# EasyEDA Pro project kuafu01_030内部老化方案.eprj, board PCB4 (continued)
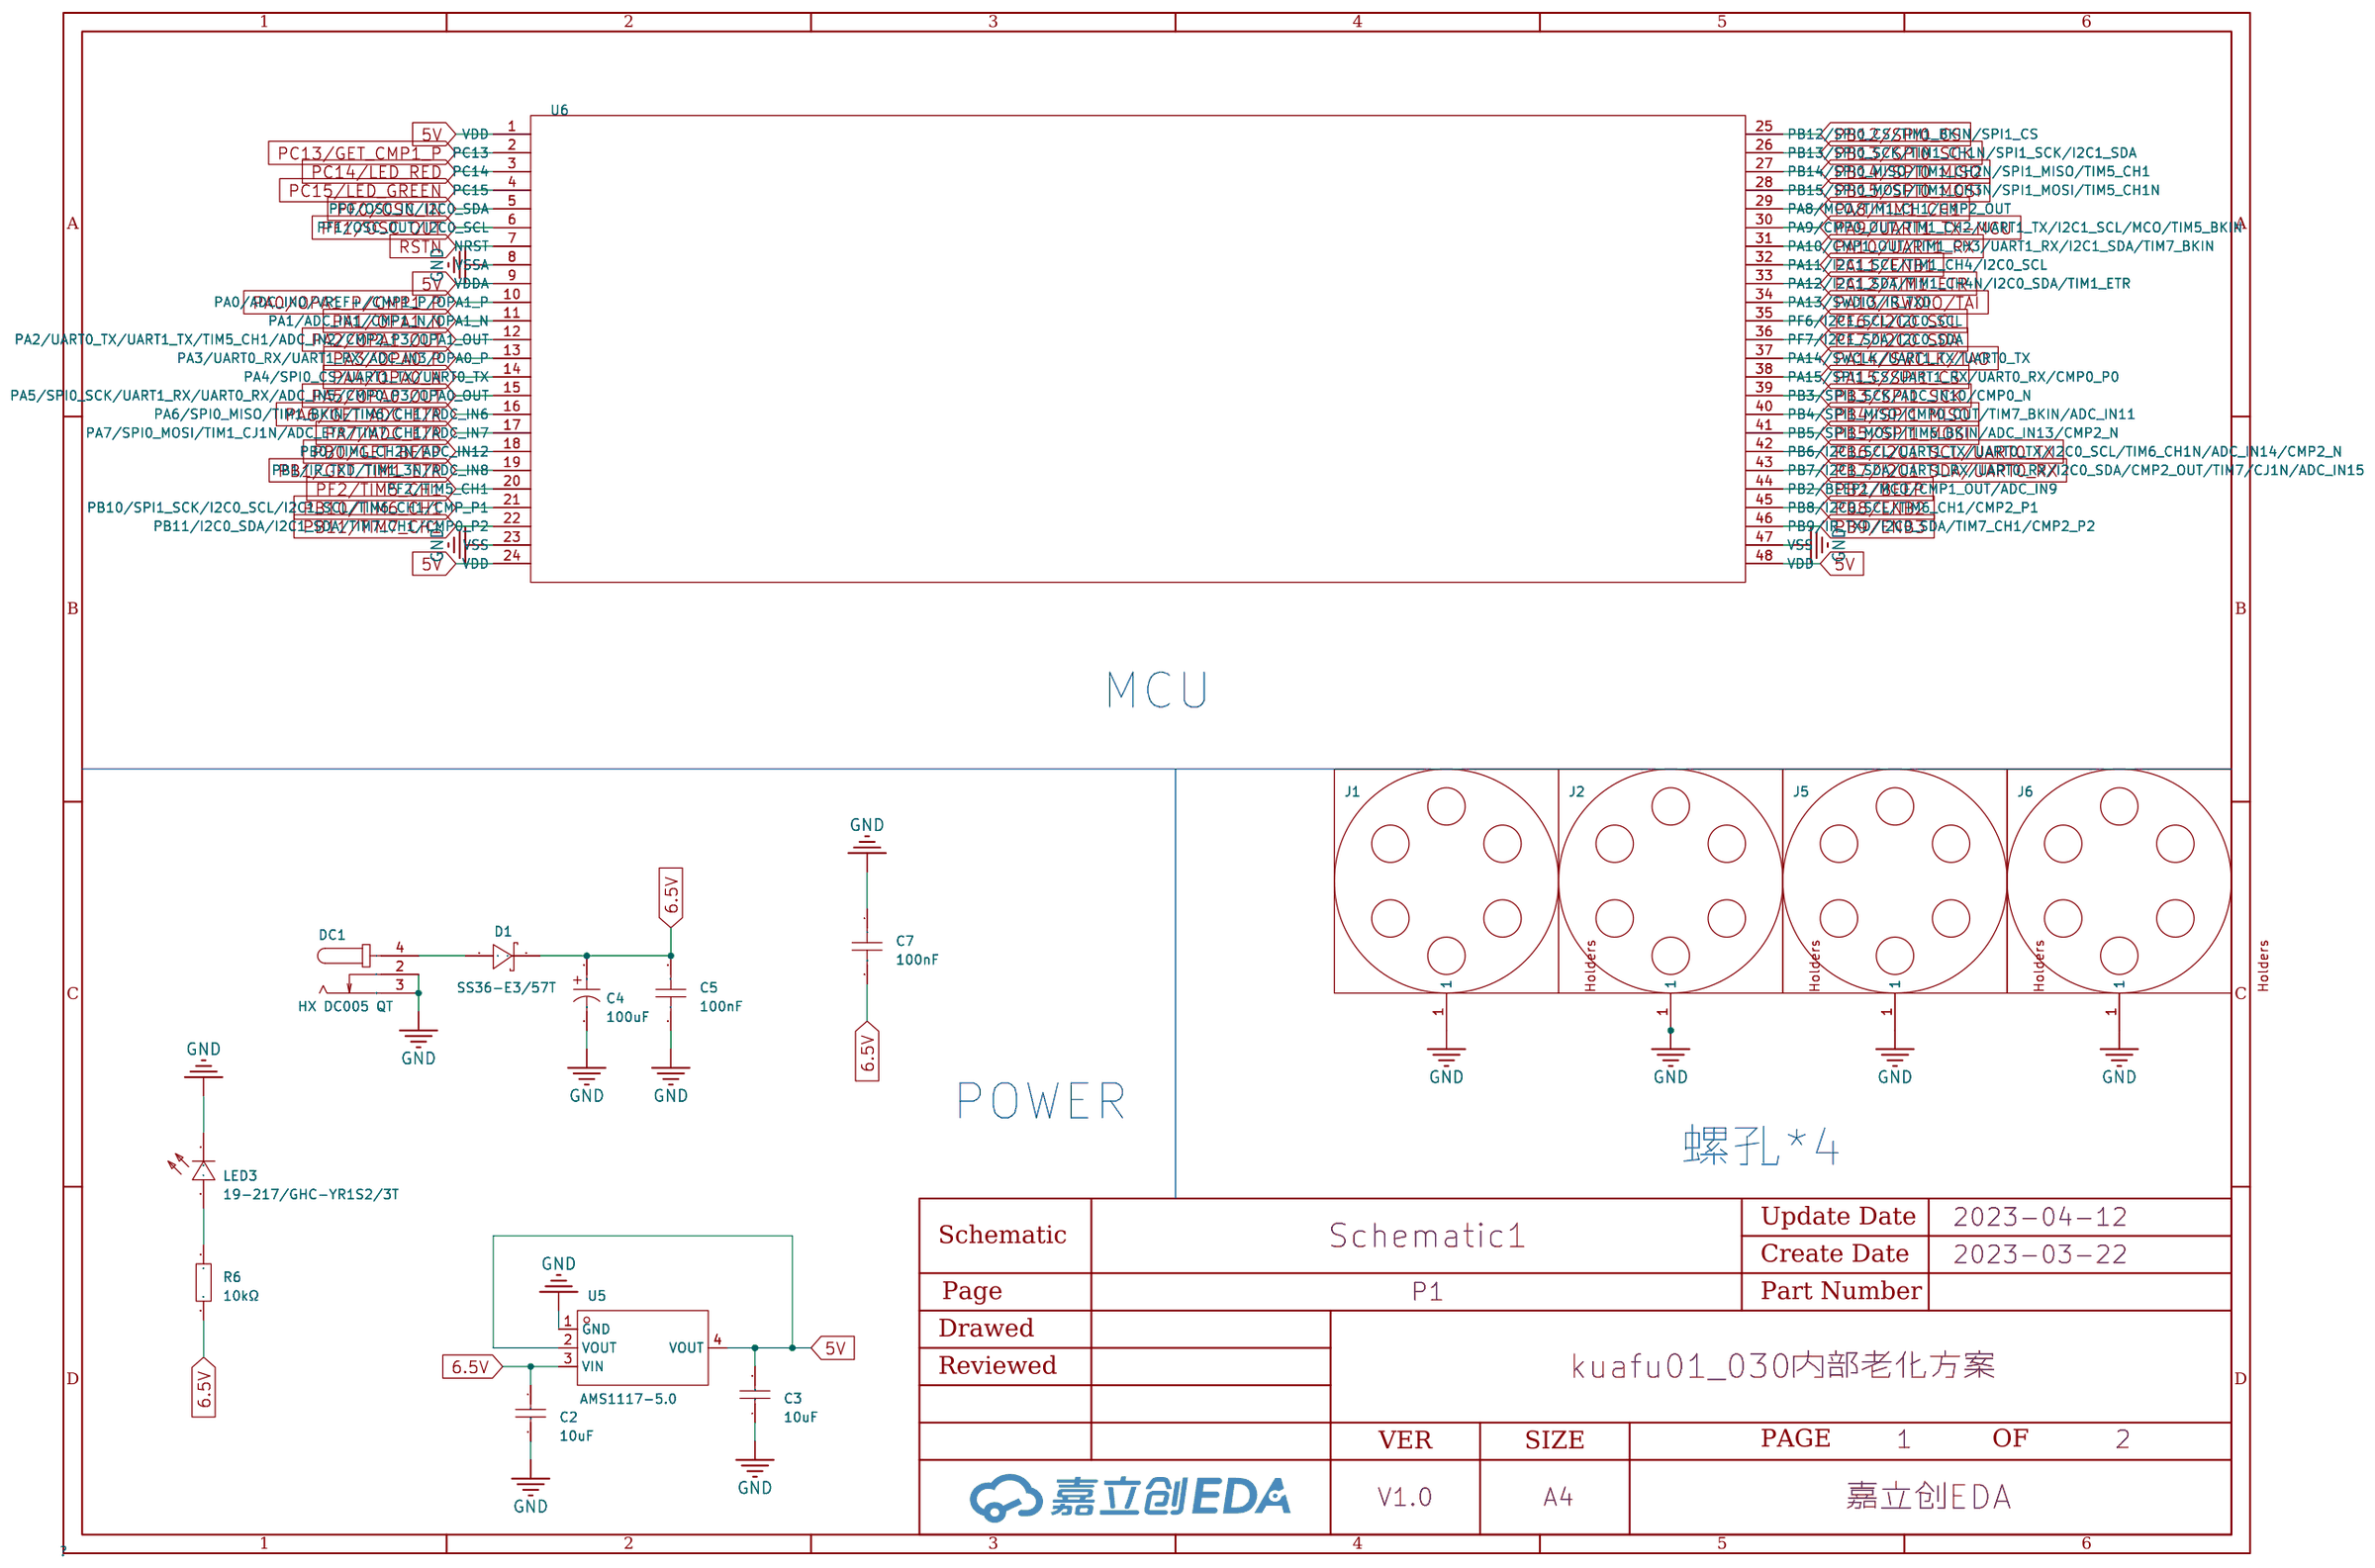
[diagram p0: P1]
## Routing (per net, layer and track width the routed paths; a pad name or vN(x,y) marks a point on that pad's centre or on a via; arc(x,y) is an arc through that point) (continued)
PA11/ENB1: length 2133.3
  Top Layer w0.254: 191.03,274.14 191.71,274.14 192.42,273.44 192.42,268.96 196.34,265.04 205.77,265.04 210.83,270.1 215.04,270.1 v1(215.67,270.73) ; v1(164.99,28.21) 164.7,28.21 164,27.51 157.47,27.51 ; 259.07,281.51 265.6,281.51 266.3,282.21 v1(266.59,282.21) ; v1(215.79,333.01) 215.5,333.01 214.8,332.31 208.27,332.31 ; 89.43,274.14 90.11,274.14 90.82,273.44 90.82,268.96 94.74,265.04 104.17,265.04 109.23,270.1 113.44,270.1 v1(114.06,270.73) ; v1(215.79,231.41) 215.5,231.41 214.8,230.71 208.27,230.71 ; 140.23,20.14 140.91,20.14 141.62,19.44 141.62,14.96 145.54,11.04 154.97,11.04 160.03,16.1 164.24,16.1 v1(164.87,16.73) ; v1(164.87,169.13) 164.24,168.5 160.03,168.5 154.97,163.44 145.54,163.44 141.62,167.36 141.62,171.84 140.91,172.54 140.23,172.54 ; v1(215.67,169.13) 215.04,168.5 210.83,168.5 205.77,163.44 196.34,163.44 192.42,167.36 192.42,171.84 191.71,172.54 191.03,172.54 ; v1(266.59,28.21) 266.3,28.21 265.6,27.51 259.07,27.51 ; 55.87,230.71 62.4,230.71 63.1,231.41 v1(63.39,231.41) ; 292.63,274.14 293.31,274.14 294.02,273.44 294.02,268.96 297.94,265.04 307.37,265.04 312.43,270.1 316.64,270.1 v1(317.26,270.73) ; v1(266.59,180.61) 266.3,180.61 265.6,179.91 259.07,179.91 ; 89.43,324.94 90.11,324.94 90.82,324.24 90.82,319.76 94.74,315.84 104.17,315.84 109.23,320.9 113.44,320.9 v1(114.06,321.53) ; v1(164.99,180.61) 164.7,180.61 164,179.91 157.47,179.91 ; v1(317.39,180.61) 317.1,180.61 316.4,179.91 309.87,179.91 ; 208.27,129.11 214.8,129.11 215.5,129.81 v1(215.79,129.81) ; 309.87,281.51 316.4,281.51 317.1,282.21 v1(317.39,282.21) ; v1(215.79,79.01) 215.5,79.01 214.8,78.31 208.27,78.31 ; 55.87,129.11 62.4,129.11 63.1,129.81 v1(63.39,129.81) ; v1(266.46,67.53) 265.84,66.9 261.63,66.9 256.57,61.84 247.14,61.84 243.22,65.76 243.22,70.24 242.51,70.94 241.83,70.94 ; 292.63,70.94 293.31,70.94 294.02,70.24 294.02,65.76 297.94,61.84 307.37,61.84 312.43,66.9 316.64,66.9 v1(317.26,67.53) ; v1(266.46,118.33) 265.84,117.7 261.63,117.7 256.57,112.64 247.14,112.64 243.22,116.56 243.22,121.04 242.51,121.74 241.83,121.74 ; v1(164.99,79.01) 164.7,79.01 164,78.31 157.47,78.31 ; 241.83,172.54 242.51,172.54 243.22,171.84 243.22,167.36 247.14,163.44 256.57,163.44 261.63,168.5 265.84,168.5 v1(266.46,169.13) ; 140.23,223.34 140.91,223.34 141.62,222.64 141.62,218.16 145.54,214.24 154.97,214.24 160.03,219.3 164.24,219.3 v1(164.87,219.93) ; 292.63,121.74 293.31,121.74 294.02,121.04 294.02,116.56 297.94,112.64 307.37,112.64 312.43,117.7 316.64,117.7 v1(317.26,118.33) ; v1(266.59,231.41) 266.3,231.41 265.6,230.71 259.07,230.71 ; 38.63,223.34 39.31,223.34 40.02,222.64 40.02,218.16 43.94,214.24 53.37,214.24 58.43,219.3 62.64,219.3 v1(63.27,219.93) ; 241.83,20.14 242.51,20.14 243.22,19.44 243.22,14.96 247.14,11.04 256.57,11.04 261.63,16.1 265.84,16.1 v1(266.46,16.73) ; v1(63.39,28.21) 63.1,28.21 62.4,27.51 55.87,27.51 ; v1(114.19,180.61) 113.9,180.61 113.2,179.91 106.67,179.91 ; v1(317.39,79.01) 317.1,79.01 316.4,78.31 309.87,78.31 ; 38.63,121.74 39.31,121.74 40.02,121.04 40.02,116.56 43.94,112.64 53.37,112.64 58.43,117.7 62.64,117.7 v1(63.27,118.33) ; 309.87,129.11 316.4,129.11 317.1,129.81 v1(317.39,129.81) ; 191.03,20.14 191.71,20.14 192.42,19.44 192.42,14.96 196.34,11.04 205.77,11.04 210.83,16.1 215.04,16.1 v1(215.67,16.73) ; 259.07,78.31 265.6,78.31 266.3,79.01 v1(266.59,79.01) ; 259.07,129.11 265.6,129.11 266.3,129.81 v1(266.59,129.81) ; 38.63,274.14 39.31,274.14 40.02,273.44 40.02,268.96 43.94,265.04 53.37,265.04 58.43,270.1 62.64,270.1 v1(63.27,270.73) ; 55.87,78.31 62.4,78.31 63.1,79.01 v1(63.39,79.01) ; 191.03,223.34 191.71,223.34 192.42,222.64 192.42,218.16 196.34,214.24 205.77,214.24 210.83,219.3 215.04,219.3 v1(215.67,219.93) ; v1(266.46,219.93) 265.84,219.3 261.63,219.3 256.57,214.24 247.14,214.24 243.22,218.16 243.22,222.64 242.51,223.34 241.83,223.34 ; v1(317.26,219.93) 316.64,219.3 312.43,219.3 307.37,214.24 297.94,214.24 294.02,218.16 294.02,222.64 293.31,223.34 292.63,223.34 ; v1(266.46,321.53) 265.84,320.9 261.63,320.9 256.57,315.84 247.14,315.84 243.22,319.76 243.22,324.24 242.51,324.94 241.83,324.94 ; v1(63.27,16.73) 62.64,16.1 58.43,16.1 53.37,11.04 43.94,11.04 40.02,14.96 40.02,19.44 39.31,20.14 38.63,20.14 ; v1(215.67,67.53) 215.04,66.9 210.83,66.9 205.77,61.84 196.34,61.84 192.42,65.76 192.42,70.24 191.71,70.94 191.03,70.94 ; 106.67,230.71 113.2,230.71 113.9,231.41 v1(114.19,231.41) ; v1(215.79,180.61) 215.5,180.61 214.8,179.91 208.27,179.91 ; 241.83,274.14 242.51,274.14 243.22,273.44 243.22,268.96 247.14,265.04 256.57,265.04 261.63,270.1 265.84,270.1 v1(266.46,270.73) ; v1(114.06,169.13) 113.44,168.5 109.23,168.5 104.17,163.44 94.74,163.44 90.82,167.36 90.82,171.84 90.11,172.54 89.43,172.54 ; 106.67,129.11 113.2,129.11 113.9,129.81 v1(114.19,129.81) ; v1(317.26,169.13) 316.64,168.5 312.43,168.5 307.37,163.44 297.94,163.44 294.02,167.36 294.02,171.84 293.31,172.54 292.63,172.54 ; 89.43,20.14 90.11,20.14 90.82,19.44 90.82,14.96 94.74,11.04 104.17,11.04 109.23,16.1 113.44,16.1 v1(114.06,16.73) ; v1(63.27,169.13) 62.64,168.5 58.43,168.5 53.37,163.44 43.94,163.44 40.02,167.36 40.02,171.84 39.31,172.54 38.63,172.54 ; 208.27,27.51 214.8,27.51 215.5,28.21 v1(215.79,28.21) ; 157.47,281.51 164,281.51 164.7,282.21 v1(164.99,282.21) ; v1(317.39,231.41) 317.1,231.41 316.4,230.71 309.87,230.71 ; v1(63.39,180.61) 63.1,180.61 62.4,179.91 55.87,179.91 ; 259.07,332.31 265.6,332.31 266.3,333.01 v1(266.59,333.01) ; v1(164.99,129.81) 164.7,129.81 164,129.11 157.47,129.11 ; v1(164.87,118.33) 164.24,117.7 160.03,117.7 154.97,112.64 145.54,112.64 141.62,116.56 141.62,121.04 140.91,121.74 140.23,121.74 ; 140.23,324.94 140.91,324.94 141.62,324.24 141.62,319.76 145.54,315.84 154.97,315.84 160.03,320.9 164.24,320.9 v1(164.87,321.53) ; v1(114.19,282.21) 113.9,282.21 113.2,281.51 106.67,281.51 ; 191.03,324.94 191.71,324.94 192.42,324.24 192.42,319.76 196.34,315.84 205.77,315.84 210.83,320.9 215.04,320.9 v1(215.67,321.53) ; v1(63.39,282.21) 63.1,282.21 62.4,281.51 55.87,281.51 ; 292.63,324.94 293.31,324.94 294.02,324.24 294.02,319.76 297.94,315.84 307.37,315.84 312.43,320.9 316.64,320.9 v1(317.26,321.53) ; 191.03,121.74 191.71,121.74 192.42,121.04 192.42,116.56 196.34,112.64 205.77,112.64 210.83,117.7 215.04,117.7 v1(215.67,118.33) ; 38.63,70.94 39.31,70.94 40.02,70.24 40.02,65.76 43.94,61.84 53.37,61.84 58.43,66.9 62.64,66.9 v1(63.27,67.53) ; v1(114.19,79.01) 113.9,79.01 113.2,78.31 106.67,78.31 ; v1(114.06,118.33) 113.44,117.7 109.23,117.7 104.17,112.64 94.74,112.64 90.82,116.56 90.82,121.04 90.11,121.74 89.43,121.74 ; 89.43,70.94 90.11,70.94 90.82,70.24 90.82,65.76 94.74,61.84 104.17,61.84 109.23,66.9 113.44,66.9 v1(114.06,67.53) ; v1(215.79,282.21) 215.5,282.21 214.8,281.51 208.27,281.51 ; 106.67,332.31 113.2,332.31 113.9,333.01 v1(114.19,333.01) ; v1(164.99,231.41) 164.7,231.41 164,230.71 157.47,230.71 ; 140.23,274.14 140.91,274.14 141.62,273.44 141.62,268.96 145.54,265.04 154.97,265.04 160.03,270.1 164.24,270.1 v1(164.87,270.73) ; v1(164.87,67.53) 164.24,66.9 160.03,66.9 154.97,61.84 145.54,61.84 141.62,65.76 141.62,70.24 140.91,70.94 140.23,70.94 ; 157.47,332.31 164,332.31 164.7,333.01 v1(164.99,333.01) ; 106.67,27.51 113.2,27.51 113.9,28.21 v1(114.19,28.21) ; 89.43,223.34 90.11,223.34 90.82,222.64 90.82,218.16 94.74,214.24 104.17,214.24 109.23,219.3 113.44,219.3 v1(114.06,219.93) ; v1(317.39,333.01) 317.1,333.01 316.4,332.31 309.87,332.31
  Bottom Layer w0.254: v1(63.39,282.21) 64.12,281.48 64.12,271.58 v1(63.27,270.73) ; v1(266.59,333.01) 267.32,332.28 267.32,322.38 v1(266.46,321.53) ; v1(317.39,79.01) 318.12,78.28 318.12,68.38 v1(317.26,67.53) ; v1(164.99,180.61) 165.72,179.88 165.72,169.98 v1(164.87,169.13) ; v1(164.87,270.73) 165.72,271.58 165.72,281.48 v1(164.99,282.21) ; v1(317.39,333.01) 318.12,332.28 318.12,322.38 v1(317.26,321.53) ; v1(114.06,270.73) 114.92,271.58 114.92,281.48 v1(114.19,282.21) ; v1(266.46,270.73) 267.32,271.58 267.32,281.48 v1(266.59,282.21) ; v1(215.79,282.21) 216.52,281.48 216.52,271.58 v1(215.67,270.73) ; v1(114.19,180.61) 114.92,179.88 114.92,169.98 v1(114.06,169.13) ; v1(266.59,231.41) 267.32,230.68 267.32,220.78 v1(266.46,219.93) ; v1(215.79,333.01) 216.52,332.28 216.52,322.38 v1(215.67,321.53) ; v1(63.39,129.81) 64.12,129.08 64.12,119.18 v1(63.27,118.33) ; v1(164.87,321.53) 165.72,322.38 165.72,332.28 v1(164.99,333.01) ; v1(215.67,67.53) 216.52,68.38 216.52,78.28 v1(215.79,79.01) ; v1(317.39,282.21) 318.12,281.48 318.12,271.58 v1(317.26,270.73) ; v1(215.79,28.21) 216.52,27.48 216.52,17.58 v1(215.67,16.73) ; v1(114.06,219.93) 114.92,220.78 114.92,230.68 v1(114.19,231.41) ; v1(317.26,219.93) 318.12,220.78 318.12,230.68 v1(317.39,231.41) ; v1(215.67,118.33) 216.52,119.18 216.52,129.08 v1(215.79,129.81) ; v1(114.06,16.73) 114.92,17.58 114.92,27.48 v1(114.19,28.21) ; v1(164.99,79.01) 165.72,78.28 165.72,68.38 v1(164.87,67.53) ; v1(63.27,67.53) 64.12,68.38 64.12,78.28 v1(63.39,79.01) ; v1(215.67,169.13) 216.52,169.98 216.52,179.88 v1(215.79,180.61) ; v1(317.39,180.61) 318.12,179.88 318.12,169.98 v1(317.26,169.13) ; v1(114.19,333.01) 114.92,332.28 114.92,322.38 v1(114.06,321.53) ; v1(266.59,28.21) 267.32,27.48 267.32,17.58 v1(266.46,16.73) ; v1(164.99,231.41) 165.72,230.68 165.72,220.78 v1(164.87,219.93) ; v1(63.39,28.21) 64.12,27.48 64.12,17.58 v1(63.27,16.73) ; v1(164.87,118.33) 165.72,119.18 165.72,129.08 v1(164.99,129.81) ; v1(266.46,169.13) 267.32,169.98 267.32,179.88 v1(266.59,180.61) ; v1(317.26,118.33) 318.12,119.18 318.12,129.08 v1(317.39,129.81) ; v1(266.46,118.33) 267.32,119.18 267.32,129.08 v1(266.59,129.81) ; v1(114.19,79.01) 114.92,78.28 114.92,68.38 v1(114.06,67.53) ; v1(63.39,180.61) 64.12,179.88 64.12,169.98 v1(63.27,169.13) ; v1(114.19,129.81) 114.92,129.08 114.92,119.18 v1(114.06,118.33) ; v1(266.59,79.01) 267.32,78.28 267.32,68.38 v1(266.46,67.53) ; v1(164.99,28.21) 165.72,27.48 165.72,17.58 v1(164.87,16.73) ; v1(63.39,231.41) 64.12,230.68 64.12,220.78 v1(63.27,219.93) ; v1(215.67,219.93) 216.52,220.78 216.52,230.68 v1(215.79,231.41)
PA12/TIM1_ETR: length 1427.7
  Top Layer w0.254: v1(166.49,171.41) 165.59,170.51 155.46,170.51 153.48,172.49 153.48,174.99 ; 208.16,78.83 208.2,78.79 214.52,78.79 215.6,79.87 v1(216.15,79.87) ; 106.56,282.03 106.6,281.99 112.92,281.99 114,283.07 v1(114.55,283.07) ; 102.68,22.59 102.68,20.09 104.66,18.11 114.79,18.11 v1(115.69,19.01) ; v1(64.89,273.01) 63.99,272.11 53.86,272.11 51.88,274.09 51.88,276.59 ; 305.88,124.19 305.88,121.69 307.86,119.71 317.99,119.71 v1(318.89,120.61) ; v1(165.35,283.07) 164.8,283.07 163.72,281.99 157.4,281.99 157.36,282.03 ; 153.48,73.39 153.48,70.89 155.46,68.91 165.59,68.91 v1(166.49,69.81) ; v1(217.29,120.61) 216.39,119.71 206.26,119.71 204.28,121.69 204.28,124.19 ; 55.76,180.43 55.8,180.39 62.12,180.39 63.2,181.47 v1(63.75,181.47) ; v1(317.75,283.07) 317.2,283.07 316.12,281.99 309.8,281.99 309.76,282.03 ; v1(216.15,283.07) 215.6,283.07 214.52,281.99 208.2,281.99 208.16,282.03 ; v1(114.55,130.67) 114,130.67 112.92,129.59 106.6,129.59 106.56,129.63 ; 157.36,129.63 157.4,129.59 163.72,129.59 164.8,130.67 v1(165.35,130.67) ; v1(166.49,273.01) 165.59,272.11 155.46,272.11 153.48,274.09 153.48,276.59 ; 153.48,124.19 153.48,121.69 155.46,119.71 165.59,119.71 v1(166.49,120.61) ; v1(268.09,120.61) 267.19,119.71 257.06,119.71 255.08,121.69 255.08,124.19 ; 157.36,231.23 157.4,231.19 163.72,231.19 164.8,232.27 v1(165.35,232.27) ; v1(317.75,130.67) 317.2,130.67 316.12,129.59 309.8,129.59 309.76,129.63 ; v1(317.75,79.87) 317.2,79.87 316.12,78.79 309.8,78.79 309.76,78.83 ; 106.56,231.23 106.6,231.19 112.92,231.19 114,232.27 v1(114.55,232.27) ; v1(268.09,323.81) 267.19,322.91 257.06,322.91 255.08,324.89 255.08,327.39 ; 255.08,174.99 255.08,172.49 257.06,170.51 267.19,170.51 v1(268.09,171.41) ; 106.56,78.83 106.6,78.79 112.92,78.79 114,79.87 v1(114.55,79.87) ; v1(266.95,232.27) 266.4,232.27 265.32,231.19 259,231.19 258.96,231.23 ; 208.16,129.63 208.2,129.59 214.52,129.59 215.6,130.67 v1(216.15,130.67) ; 153.48,225.79 153.48,223.29 155.46,221.31 165.59,221.31 v1(166.49,222.21) ; 208.16,332.83 208.2,332.79 214.52,332.79 215.6,333.87 v1(216.15,333.87) ; v1(266.95,333.87) 266.4,333.87 265.32,332.79 259,332.79 258.96,332.83 ; v1(217.29,323.81) 216.39,322.91 206.26,322.91 204.28,324.89 204.28,327.39 ; v1(114.55,181.47) 114,181.47 112.92,180.39 106.6,180.39 106.56,180.43 ; 255.08,225.79 255.08,223.29 257.06,221.31 267.19,221.31 v1(268.09,222.21) ; v1(165.35,181.47) 164.8,181.47 163.72,180.39 157.4,180.39 157.36,180.43 ; v1(318.89,222.21) 317.99,221.31 307.86,221.31 305.88,223.29 305.88,225.79 ; 258.96,282.03 259,281.99 265.32,281.99 266.4,283.07 v1(266.95,283.07) ; v1(266.95,79.87) 266.4,79.87 265.32,78.79 259,78.79 258.96,78.83 ; 204.28,174.99 204.28,172.49 206.26,170.51 216.39,170.51 v1(217.29,171.41) ; v1(318.89,273.01) 317.99,272.11 307.86,272.11 305.88,274.09 305.88,276.59 ; 51.88,225.79 51.88,223.29 53.86,221.31 63.99,221.31 v1(64.89,222.21) ; v1(317.75,232.27) 317.2,232.27 316.12,231.19 309.8,231.19 309.76,231.23 ; v1(268.09,19.01) 267.19,18.11 257.06,18.11 255.08,20.09 255.08,22.59 ; 55.76,231.23 55.8,231.19 62.12,231.19 63.2,232.27 v1(63.75,232.27) ; 305.88,327.39 305.88,324.89 307.86,322.91 317.99,322.91 v1(318.89,323.81) ; 55.76,282.03 55.8,281.99 62.12,281.99 63.2,283.07 v1(63.75,283.07) ; v1(266.95,29.07) 266.4,29.07 265.32,27.99 259,27.99 258.96,28.03 ; 305.88,73.39 305.88,70.89 307.86,68.91 317.99,68.91 v1(318.89,69.81) ; 51.88,73.39 51.88,70.89 53.86,68.91 63.99,68.91 v1(64.89,69.81) ; v1(216.15,181.47) 215.6,181.47 214.52,180.39 208.2,180.39 208.16,180.43 ; 102.68,276.59 102.68,274.09 104.66,272.11 114.79,272.11 v1(115.69,273.01) ; 157.36,78.83 157.4,78.79 163.72,78.79 164.8,79.87 v1(165.35,79.87) ; 153.48,327.39 153.48,324.89 155.46,322.91 165.59,322.91 v1(166.49,323.81) ; 255.08,73.39 255.08,70.89 257.06,68.91 267.19,68.91 v1(268.09,69.81) ; v1(114.55,29.07) 114,29.07 112.92,27.99 106.6,27.99 106.56,28.03 ; 157.36,28.03 157.4,27.99 163.72,27.99 164.8,29.07 v1(165.35,29.07) ; v1(64.89,19.01) 63.99,18.11 53.86,18.11 51.88,20.09 51.88,22.59 ; v1(266.95,130.67) 266.4,130.67 265.32,129.59 259,129.59 258.96,129.63 ; 204.28,225.79 204.28,223.29 206.26,221.31 216.39,221.31 v1(217.29,222.21) ; v1(64.89,120.61) 63.99,119.71 53.86,119.71 51.88,121.69 51.88,124.19 ; v1(217.29,69.81) 216.39,68.91 206.26,68.91 204.28,70.89 204.28,73.39 ; 102.68,327.39 102.68,324.89 104.66,322.91 114.79,322.91 v1(115.69,323.81) ; 204.28,276.59 204.28,274.09 206.26,272.11 216.39,272.11 v1(217.29,273.01) ; 106.56,332.83 106.6,332.79 112.92,332.79 114,333.87 v1(114.55,333.87) ; 102.68,174.99 102.68,172.49 104.66,170.51 114.79,170.51 v1(115.69,171.41) ; v1(64.89,171.41) 63.99,170.51 53.86,170.51 51.88,172.49 51.88,174.99 ; 102.68,73.39 102.68,70.89 104.66,68.91 114.79,68.91 v1(115.69,69.81) ; 157.36,332.83 157.4,332.79 163.72,332.79 164.8,333.87 v1(165.35,333.87) ; v1(63.75,79.87) 63.2,79.87 62.12,78.79 55.8,78.79 55.76,78.83 ; 258.96,180.43 259,180.39 265.32,180.39 266.4,181.47 v1(266.95,181.47) ; v1(115.69,222.21) 114.79,221.31 104.66,221.31 102.68,223.29 102.68,225.79 ; 102.68,124.19 102.68,121.69 104.66,119.71 114.79,119.71 v1(115.69,120.61) ; v1(268.09,273.01) 267.19,272.11 257.06,272.11 255.08,274.09 255.08,276.59 ; 309.76,332.83 309.8,332.79 316.12,332.79 317.2,333.87 v1(317.75,333.87) ; 309.76,180.43 309.8,180.39 316.12,180.39 317.2,181.47 v1(317.75,181.47) ; v1(216.15,29.07) 215.6,29.07 214.52,27.99 208.2,27.99 208.16,28.03 ; v1(216.15,232.27) 215.6,232.27 214.52,231.19 208.2,231.19 208.16,231.23 ; v1(318.89,171.41) 317.99,170.51 307.86,170.51 305.88,172.49 305.88,174.99 ; v1(166.49,19.01) 165.59,18.11 155.46,18.11 153.48,20.09 153.48,22.59 ; 55.76,28.03 55.8,27.99 62.12,27.99 63.2,29.07 v1(63.75,29.07) ; 55.76,129.63 55.8,129.59 62.12,129.59 63.2,130.67 v1(63.75,130.67) ; v1(217.29,19.01) 216.39,18.11 206.26,18.11 204.28,20.09 204.28,22.59
  Bottom Layer w0.254: v1(166.49,120.61) 166.49,129.53 v1(165.35,130.67) ; v1(63.75,181.47) 64.89,180.33 v1(64.89,171.41) ; v1(166.49,323.81) 166.49,332.73 v1(165.35,333.87) ; v1(216.15,333.87) 217.29,332.73 v1(217.29,323.81) ; v1(216.15,130.67) 217.29,129.53 v1(217.29,120.61) ; v1(317.75,130.67) 318.89,129.53 v1(318.89,120.61) ; v1(115.69,171.41) 115.69,180.33 v1(114.55,181.47) ; v1(63.75,29.07) 64.89,27.93 v1(64.89,19.01) ; v1(114.55,29.07) 115.69,27.93 v1(115.69,19.01) ; v1(268.09,222.21) 268.09,231.13 v1(266.95,232.27) ; v1(318.89,222.21) 318.89,231.13 v1(317.75,232.27) ; v1(318.89,273.01) 318.89,281.93 v1(317.75,283.07) ; v1(217.29,171.41) 217.29,180.33 v1(216.15,181.47) ; v1(114.55,232.27) 115.69,231.13 v1(115.69,222.21) ; v1(165.35,79.87) 166.49,78.73 v1(166.49,69.81) ; v1(217.29,222.21) 217.29,231.13 v1(216.15,232.27) ; v1(166.49,171.41) 166.49,180.33 v1(165.35,181.47) ; v1(268.09,273.01) 268.09,281.93 v1(266.95,283.07) ; v1(268.09,323.81) 268.09,332.73 v1(266.95,333.87) ; v1(63.75,79.87) 64.89,78.73 v1(64.89,69.81) ; v1(166.49,222.21) 166.49,231.13 v1(165.35,232.27) ; v1(318.89,69.81) 318.89,78.73 v1(317.75,79.87) ; v1(216.15,283.07) 217.29,281.93 v1(217.29,273.01) ; v1(268.09,120.61) 268.09,129.53 v1(266.95,130.67) ; v1(317.75,181.47) 318.89,180.33 v1(318.89,171.41) ; v1(115.69,69.81) 115.69,78.73 v1(114.55,79.87) ; v1(266.95,29.07) 268.09,27.93 v1(268.09,19.01) ; v1(166.49,19.01) 166.49,27.93 v1(165.35,29.07) ; v1(63.75,283.07) 64.89,281.93 v1(64.89,273.01) ; v1(63.75,130.67) 64.89,129.53 v1(64.89,120.61) ; v1(318.89,323.81) 318.89,332.73 v1(317.75,333.87) ; v1(114.55,130.67) 115.69,129.53 v1(115.69,120.61) ; v1(114.55,283.07) 115.69,281.93 v1(115.69,273.01) ; v1(166.49,273.01) 166.49,281.93 v1(165.35,283.07) ; v1(268.09,69.81) 268.09,78.73 v1(266.95,79.87) ; v1(216.15,29.07) 217.29,27.93 v1(217.29,19.01) ; v1(217.29,69.81) 217.29,78.73 v1(216.15,79.87) ; v1(115.69,323.81) 115.69,332.73 v1(114.55,333.87) ; v1(64.89,222.21) 64.89,231.13 v1(63.75,232.27) ; v1(268.09,171.41) 268.09,180.33 v1(266.95,181.47)
PA13/SWDIO/TAI: length 2155.1
  Top Layer w0.254: 157.27,79.29 157.3,79.32 163.02,79.32 164.15,80.45 165.48,80.45 v1(165.71,80.68) ; v1(149.5,340.66) 148.22,341.94 148.22,343.7 ; v1(165.71,29.88) 165.48,29.65 164.15,29.65 163.02,28.52 157.3,28.52 157.27,28.49 ; 208.07,333.29 208.1,333.32 213.82,333.32 214.95,334.45 216.28,334.45 v1(216.51,334.68) ; 249.82,242.1 249.82,240.34 v1(251.1,239.06) ; v1(301.9,340.66) 300.62,341.94 300.62,343.7 ; 157.05,202.09 157.05,199.72 156.09,198.77 147.46,198.77 145.31,196.62 145.31,193.53 147.62,191.22 ; 300.02,292.82 297.71,295.13 297.71,298.22 299.86,300.37 308.49,300.37 309.45,301.32 309.45,303.69 ; 106.47,180.89 106.5,180.92 112.22,180.92 113.35,182.05 114.68,182.05 v1(114.91,182.28) ; 96.82,292.82 94.51,295.13 94.51,298.22 96.66,300.37 105.29,300.37 106.25,301.32 106.25,303.69 ; v1(318.11,233.08) 317.88,232.85 316.55,232.85 315.42,231.72 309.7,231.72 309.67,231.69 ; v1(301.9,188.26) 300.62,189.54 300.62,191.3 ; 96.82,89.62 94.51,91.93 94.51,95.02 96.66,97.17 105.29,97.17 106.25,98.12 106.25,100.49 ; v1(200.3,289.86) 199.02,291.14 199.02,292.9 ; 96.82,242.02 94.51,244.33 94.51,247.42 96.66,249.57 105.29,249.57 106.25,250.52 106.25,252.89 ; v1(149.5,289.86) 148.22,291.14 148.22,292.9 ; 249.82,191.3 249.82,189.54 v1(251.1,188.26) ; 208.07,130.09 208.1,130.12 213.82,130.12 214.95,131.25 216.28,131.25 v1(216.51,131.48) ; v1(114.91,283.88) 114.68,283.65 113.35,283.65 112.22,282.52 106.5,282.52 106.47,282.49 ; 198.42,38.82 196.11,41.13 196.11,44.22 198.26,46.37 206.89,46.37 207.85,47.32 207.85,49.69 ; 96.82,191.22 94.51,193.53 94.51,196.62 96.66,198.77 105.29,198.77 106.25,199.72 106.25,202.09 ; 207.85,303.69 207.85,301.32 206.89,300.37 198.26,300.37 196.11,298.22 196.11,295.13 198.42,292.82 ; 157.05,49.69 157.05,47.32 156.09,46.37 147.46,46.37 145.31,44.22 145.31,41.13 147.62,38.82 ; v1(165.71,283.88) 165.48,283.65 164.15,283.65 163.02,282.52 157.3,282.52 157.27,282.49 ; v1(98.7,137.46) 97.42,138.74 97.42,140.5 ; 106.47,79.29 106.5,79.32 112.22,79.32 113.35,80.45 114.68,80.45 v1(114.91,80.68) ; 198.42,343.62 196.11,345.93 196.11,349.02 198.26,351.17 206.89,351.17 207.85,352.12 207.85,354.49 ; 300.62,89.7 300.62,87.94 v1(301.9,86.66) ; 46.62,38.9 46.62,37.14 v1(47.9,35.86) ; v1(301.9,137.46) 300.62,138.74 300.62,140.5 ; v1(267.31,131.48) 267.08,131.25 265.75,131.25 264.62,130.12 258.9,130.12 258.87,130.09 ; 309.67,282.49 309.7,282.52 315.42,282.52 316.55,283.65 317.88,283.65 v1(318.11,283.88) ; v1(318.11,131.48) 317.88,131.25 316.55,131.25 315.42,130.12 309.7,130.12 309.67,130.09 ; 46.02,140.42 43.71,142.73 43.71,145.82 45.86,147.97 54.49,147.97 55.45,148.92 55.45,151.29 ; v1(200.3,239.06) 199.02,240.34 199.02,242.1 ; v1(200.3,188.26) 199.02,189.54 199.02,191.3 ; 157.27,333.29 157.3,333.32 163.02,333.32 164.15,334.45 165.48,334.45 v1(165.71,334.68) ; v1(149.5,86.66) 148.22,87.94 148.22,89.7 ; v1(64.11,283.88) 63.88,283.65 62.55,283.65 61.42,282.52 55.7,282.52 55.67,282.49 ; v1(114.91,29.88) 114.68,29.65 113.35,29.65 112.22,28.52 106.5,28.52 106.47,28.49 ; v1(47.9,86.66) 46.62,87.94 46.62,89.7 ; 157.27,231.69 157.3,231.72 163.02,231.72 164.15,232.85 165.48,232.85 v1(165.71,233.08) ; 97.42,343.7 97.42,341.94 v1(98.7,340.66) ; 249.22,38.82 246.91,41.13 246.91,44.22 249.06,46.37 257.69,46.37 258.65,47.32 258.65,49.69 ; 300.02,191.22 297.71,193.53 297.71,196.62 299.86,198.77 308.49,198.77 309.45,199.72 309.45,202.09 ; v1(267.31,334.68) 267.08,334.45 265.75,334.45 264.62,333.32 258.9,333.32 258.87,333.29 ; 198.42,89.62 196.11,91.93 196.11,95.02 198.26,97.17 206.89,97.17 207.85,98.12 207.85,100.49 ; 148.22,242.1 148.22,240.34 v1(149.5,239.06) ; 249.82,38.9 249.82,37.14 v1(251.1,35.86) ; 258.65,354.49 258.65,352.12 257.69,351.17 249.06,351.17 246.91,349.02 246.91,345.93 249.22,343.62 ; 157.05,354.49 157.05,352.12 156.09,351.17 147.46,351.17 145.31,349.02 145.31,345.93 147.62,343.62 ; 300.62,242.1 300.62,240.34 v1(301.9,239.06) ; 55.45,100.49 55.45,98.12 54.49,97.17 45.86,97.17 43.71,95.02 43.71,91.93 46.02,89.62 ; 199.02,89.7 199.02,87.94 v1(200.3,86.66) ; 55.67,79.29 55.7,79.32 61.42,79.32 62.55,80.45 63.88,80.45 v1(64.11,80.68) ; 106.25,354.49 106.25,352.12 105.29,351.17 96.66,351.17 94.51,349.02 94.51,345.93 96.82,343.62 ; v1(47.9,188.26) 46.62,189.54 46.62,191.3 ; 148.22,38.9 148.22,37.14 v1(149.5,35.86) ; 148.22,191.3 148.22,189.54 v1(149.5,188.26) ; 208.07,282.49 208.1,282.52 213.82,282.52 214.95,283.65 216.28,283.65 v1(216.51,283.88) ; 55.67,130.09 55.7,130.12 61.42,130.12 62.55,131.25 63.88,131.25 v1(64.11,131.48) ; 258.65,252.89 258.65,250.52 257.69,249.57 249.06,249.57 246.91,247.42 246.91,244.33 249.22,242.02 ; 55.45,252.89 55.45,250.52 54.49,249.57 45.86,249.57 43.71,247.42 43.71,244.33 46.02,242.02 ; 97.42,191.3 97.42,189.54 v1(98.7,188.26) ; 147.62,292.82 145.31,295.13 145.31,298.22 147.46,300.37 156.09,300.37 157.05,301.32 157.05,303.69 ; v1(64.11,182.28) 63.88,182.05 62.55,182.05 61.42,180.92 55.7,180.92 55.67,180.89 ; v1(98.7,239.06) 97.42,240.34 97.42,242.1 ; v1(267.31,283.88) 267.08,283.65 265.75,283.65 264.62,282.52 258.9,282.52 258.87,282.49 ; 157.05,151.29 157.05,148.92 156.09,147.97 147.46,147.97 145.31,145.82 145.31,142.73 147.62,140.42 ; 97.42,38.9 97.42,37.14 v1(98.7,35.86) ; 198.42,191.22 196.11,193.53 196.11,196.62 198.26,198.77 206.89,198.77 207.85,199.72 207.85,202.09 ; 300.02,242.02 297.71,244.33 297.71,247.42 299.86,249.57 308.49,249.57 309.45,250.52 309.45,252.89 ; 249.82,140.5 249.82,138.74 v1(251.1,137.46) ; 258.87,231.69 258.9,231.72 264.62,231.72 265.75,232.85 267.08,232.85 v1(267.31,233.08) ; 208.07,231.69 208.1,231.72 213.82,231.72 214.95,232.85 216.28,232.85 v1(216.51,233.08) ; 208.07,79.29 208.1,79.32 213.82,79.32 214.95,80.45 216.28,80.45 v1(216.51,80.68) ; 46.02,191.22 43.71,193.53 43.71,196.62 45.86,198.77 54.49,198.77 55.45,199.72 55.45,202.09 ; 249.82,89.7 249.82,87.94 v1(251.1,86.66) ; 157.27,130.09 157.3,130.12 163.02,130.12 164.15,131.25 165.48,131.25 v1(165.71,131.48) ; v1(267.31,80.68) 267.08,80.45 265.75,80.45 264.62,79.32 258.9,79.32 258.87,79.29 ; 148.22,140.5 148.22,138.74 v1(149.5,137.46) ; v1(318.11,334.68) 317.88,334.45 316.55,334.45 315.42,333.32 309.7,333.32 309.67,333.29 ; 106.47,231.69 106.5,231.72 112.22,231.72 113.35,232.85 114.68,232.85 v1(114.91,233.08) ; 300.02,343.62 297.71,345.93 297.71,349.02 299.86,351.17 308.49,351.17 309.45,352.12 309.45,354.49 ; v1(251.1,289.86) 249.82,291.14 249.82,292.9 ; 198.42,140.42 196.11,142.73 196.11,145.82 198.26,147.97 206.89,147.97 207.85,148.92 207.85,151.29 ; v1(47.9,289.86) 46.62,291.14 46.62,292.9 ; 157.05,100.49 157.05,98.12 156.09,97.17 147.46,97.17 145.31,95.02 145.31,91.93 147.62,89.62 ; 249.22,140.42 246.91,142.73 246.91,145.82 249.06,147.97 257.69,147.97 258.65,148.92 258.65,151.29 ; 106.47,333.29 106.5,333.32 112.22,333.32 113.35,334.45 114.68,334.45 v1(114.91,334.68) ; v1(251.1,340.66) 249.82,341.94 249.82,343.7 ; 199.02,140.5 199.02,138.74 v1(200.3,137.46) ; 46.62,140.5 46.62,138.74 v1(47.9,137.46) ; 199.02,343.7 199.02,341.94 v1(200.3,340.66) ; 300.02,140.42 297.71,142.73 297.71,145.82 299.86,147.97 308.49,147.97 309.45,148.92 309.45,151.29 ; v1(267.31,29.88) 267.08,29.65 265.75,29.65 264.62,28.52 258.9,28.52 258.87,28.49 ; 258.65,303.69 258.65,301.32 257.69,300.37 249.06,300.37 246.91,298.22 246.91,295.13 249.22,292.82 ; 258.65,100.49 258.65,98.12 257.69,97.17 249.06,97.17 246.91,95.02 246.91,91.93 249.22,89.62 ; v1(114.91,131.48) 114.68,131.25 113.35,131.25 112.22,130.12 106.5,130.12 106.47,130.09 ; v1(301.9,289.86) 300.62,291.14 300.62,292.9 ; 157.27,180.89 157.3,180.92 163.02,180.92 164.15,182.05 165.48,182.05 v1(165.71,182.28) ; 157.05,252.89 157.05,250.52 156.09,249.57 147.46,249.57 145.31,247.42 145.31,244.33 147.62,242.02 ; v1(216.51,182.28) 216.28,182.05 214.95,182.05 213.82,180.92 208.1,180.92 208.07,180.89 ; 46.62,242.1 46.62,240.34 v1(47.9,239.06) ; 55.67,231.69 55.7,231.72 61.42,231.72 62.55,232.85 63.88,232.85 v1(64.11,233.08) ; 55.45,49.69 55.45,47.32 54.49,46.37 45.86,46.37 43.71,44.22 43.71,41.13 46.02,38.82 ; 258.87,180.89 258.9,180.92 264.62,180.92 265.75,182.05 267.08,182.05 v1(267.31,182.28) ; 106.25,151.29 106.25,148.92 105.29,147.97 96.66,147.97 94.51,145.82 94.51,142.73 96.82,140.42 ; v1(98.7,86.66) 97.42,87.94 97.42,89.7 ; v1(318.11,182.28) 317.88,182.05 316.55,182.05 315.42,180.92 309.7,180.92 309.67,180.89 ; v1(216.51,29.88) 216.28,29.65 214.95,29.65 213.82,28.52 208.1,28.52 208.07,28.49 ; v1(318.11,80.68) 317.88,80.45 316.55,80.45 315.42,79.32 309.7,79.32 309.67,79.29 ; 97.42,292.9 97.42,291.14 v1(98.7,289.86) ; 309.45,100.49 309.45,98.12 308.49,97.17 299.86,97.17 297.71,95.02 297.71,91.93 300.02,89.62 ; 258.65,202.09 258.65,199.72 257.69,198.77 249.06,198.77 246.91,196.62 246.91,193.53 249.22,191.22 ; v1(64.11,29.88) 63.88,29.65 62.55,29.65 61.42,28.52 55.7,28.52 55.67,28.49 ; 96.82,38.82 94.51,41.13 94.51,44.22 96.66,46.37 105.29,46.37 106.25,47.32 106.25,49.69 ; 55.45,303.69 55.45,301.32 54.49,300.37 45.86,300.37 43.71,298.22 43.71,295.13 46.02,292.82 ; 198.42,242.02 196.11,244.33 196.11,247.42 198.26,249.57 206.89,249.57 207.85,250.52 207.85,252.89 ; v1(200.3,35.86) 199.02,37.14 199.02,38.9